# EasyEDA Pro project ProProject_IMUSensorNodes202312.epro, board 1_4_拼板20240123（带编号）
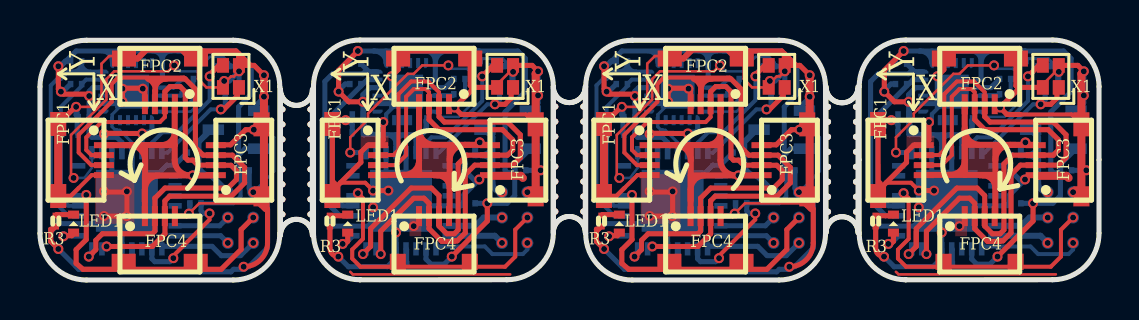
[diagram p4: board, top side]
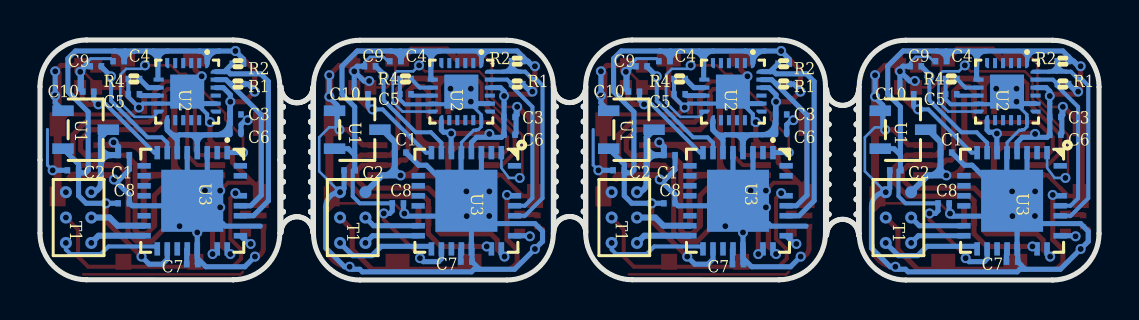
[diagram p5: board, bottom side, seen from below]

Outline 52.99 x 12.01 mm; copper layers: Top Layer, Bottom Layer. Coordinates in mm from the lower left corner of the outline.
Outline path: 0,9.67 0,2.33 arc(0.68,0.68) 2.33,0 9.67,0 arc(11.32,0.68) 12,2.33 12,9.67 arc(11.32,11.32) 9.67,12 2.33,12 arc(0.68,11.32) 0,9.67 ; 13.69,9.68 arc(14.37,11.33) 16.02,12.01 23.35,12.01 arc(25,11.33) 25.69,9.68 25.69,2.34 arc(25,0.7) 23.35,0.01 16.01,0.01 16.02,0.01 arc(14.37,0.7) 13.69,2.35 13.69,9.68 ; 27.31,9.67 27.31,2.33 arc(27.99,0.68) 29.64,0 36.97,0 arc(38.62,0.68) 39.31,2.33 39.31,9.67 arc(38.62,11.32) 36.97,12 29.64,12 arc(27.99,11.32) 27.31,9.67 ; 40.99,9.68 arc(41.67,11.33) 43.32,12.01 50.66,12.01 arc(52.31,11.33) 52.99,9.68 52.99,2.34 arc(52.31,0.7) 50.66,0.01 43.31,0.01 43.32,0.01 arc(41.67,0.7) 40.99,2.35 40.99,9.68
Stack: Top Layer 0.035mm / Dielectric1 1.51mm FR4 er 4.5 / Bottom Layer 0.035mm

## Design rules (mm)
template: 自定义配置
spacing copperThickness1oz (default): track to track 0.102, other pairs 0.152 to 0.3
spacing copperThickness2oz: track to track 0.203, other pairs 0.152 to 0.3
track width copperThickness1oz (default): min 0.127, default 0.254, max 2.54
track width copperThickness2oz: min 0.203, default 0.254, max 2.54
differential pair differentialPair (default): width min 0.127, default 0.254, max 2.54; gap min 0.152, default 0.152
via viaSize (default): diameter min 0.5, default 0.61, max 10; hole min 0.3, default 0.305, max 6.299
net GND uses copperRegion1

## Placement (name value [footprint] x y rotation side)
C1  -  [C0201]  7.65 6.38 180 bottom
C1#2  -  [C0201]  21.49 6.25 180 bottom
C1#3  -  [C0201]  34.96 6.38 180 bottom
C1#4  -  [C0201]  48.8 6.25 180 bottom
C2  -  [C0201]  10.19 5.49 0 bottom
C2#2  -  [C0201]  24.03 5.49 0 bottom
C2#3  -  [C0201]  37.5 5.49 0 bottom
C2#4  -  [C0201]  51.34 5.49 0 bottom
C3  -  [C0201]  15.91 8.28 180 bottom
C3#2  -  [C0201]  2.19 8.16 180 bottom
C3#3  -  [C0201]  29.5 8.16 180 bottom
C3#4  -  [C0201]  43.21 8.28 180 bottom
C4  -  [C0201]  7.91 10.95 0 bottom
C4#2  -  [C0201]  21.75 10.95 0 bottom
C4#3  -  [C0201]  35.21 10.95 0 bottom
C4#4  -  [C0201]  49.05 10.95 0 bottom
C5  -  [C0201]  7.4 9.3 180 bottom
C5#2  -  [C0201]  20.99 9.3 180 bottom
C5#3  -  [C0201]  34.7 9.3 180 bottom
C5#4  -  [C0201]  48.29 9.3 180 bottom
C6  -  [C0201]  2.19 7.27 0 bottom
C6#2  -  [C0201]  15.91 7.39 0 bottom
C6#3  -  [C0201]  29.5 7.27 0 bottom
C6#4  -  [C0201]  43.21 7.39 0 bottom
C7  -  [C0201]  4.35 0.92 0 bottom
C7#2  -  [C0201]  18.06 0.79 0 bottom
C7#3  -  [C0201]  31.65 0.92 0 bottom
C7#4  -  [C0201]  45.37 0.79 0 bottom
C8  -  [C0201]  21.49 3.84 180 bottom
C8#2  -  [C0201]  7.78 3.84 180 bottom
C8#3  -  [C0201]  35.08 3.84 180 bottom
C8#4  -  [C0201]  48.8 3.84 180 bottom
C9  -  [C0201]  9.17 10.7 180 bottom
C9#2  -  [C0201]  22.89 10.7 180 bottom
C9#3  -  [C0201]  36.48 10.7 180 bottom
C9#4  -  [C0201]  50.2 10.7 180 bottom
C10  -  [C0201]  9.56 9.3 0 bottom
C10#2  -  [C0201]  23.27 9.43 0 bottom
C10#3  -  [C0201]  36.86 9.3 0 bottom
C10#4  -  [C0201]  50.58 9.43 0 bottom
FPC1  -  [fpc-0.5mm-4p-h1.0#2]  44.22 6 270 top
FPC1#2  -  [fpc-0.5mm-4p-h1.0#2]  16.92 6 270 top
FPC1#3  -  [fpc-0.5mm-4p-h1.0#2]  3.2 6 270 top
FPC1#4  -  [fpc-0.5mm-4p-h1.0#2]  30.5 6 270 top
FPC2  -  [fpc-0.5mm-4p-h1.0#2]  6 8.8 180 top
FPC2#2  -  [fpc-0.5mm-4p-h1.0#2]  19.72 8.8 180 top
FPC2#3  -  [fpc-0.5mm-4p-h1.0#2]  47.02 8.8 180 top
FPC2#4  -  [fpc-0.5mm-4p-h1.0#2]  33.31 8.8 180 top
FPC3  -  [fpc-0.5mm-4p-h1.0#3]  36.1 6 90 top
FPC3#2  -  [fpc-0.5mm-4p-h1.0#3]  22.52 6 90 top
FPC3#3  -  [fpc-0.5mm-4p-h1.0#3]  49.82 6 90 top
FPC3#4  -  [fpc-0.5mm-4p-h1.0#3]  8.8 6 90 top
FPC4  -  [fpc-0.5mm-4p-h1.0]  47.02 3.2 0 top
FPC4#2  -  [fpc-0.5mm-4p-h1.0]  19.72 3.2 0 top
FPC4#3  -  [fpc-0.5mm-4p-h1.0#2]  33.31 3.2 0 top
FPC4#4  -  [fpc-0.5mm-4p-h1.0#2]  6 3.2 0 top
LED1  -  [LED0402]  1.68 2.82 90 top
LED1#2  -  [LED0402]  15.4 2.82 90 top
LED1#3  -  [LED0402]  28.99 2.82 90 top
LED1#4  -  [LED0402]  42.7 2.82 90 top
R1  -  [R0201]  1.81 9.81 0 bottom
R1#2  -  [R0201]  15.78 9.81 0 bottom
R1#3  -  [R0201]  29.11 9.81 0 bottom
R1#4  -  [R0201]  43.08 9.81 0 bottom
R2  -  [R0201]  1.81 10.95 0 bottom
R2#2  -  [R0201]  15.78 10.82 0 bottom
R2#3  -  [R0201]  29.11 10.95 0 bottom
R2#4  -  [R0201]  43.08 10.82 0 bottom
R3  -  [R0201]  41.81 2.95 270 top
R3#2  -  [R0201]  0.79 2.95 270 top
R3#3  -  [R0201]  14.51 2.95 270 top
R3#4  -  [R0201]  28.1 2.95 270 top
R4  -  [R0201]  7.4 10.06 180 bottom
R4#2  -  [R0201]  20.99 10.06 180 bottom
R4#3  -  [R0201]  34.7 10.06 180 bottom
R4#4  -  [R0201]  48.29 10.06 180 bottom
T1  -  [test]  50.42 4.4 270 bottom
T1#2  -  [test]  23.12 4.4 270 bottom
T1#3  -  [test]  9.4 4.4 270 bottom
T1#4  -  [test]  36.71 4.4 270 bottom
U1  -  [SOT-23-3_L2.9-W1.6-P1.90-LS2.8-BR]  9.81 7.52 0 bottom
U1#2  -  [SOT-23-3_L2.9-W1.6-P1.90-LS2.8-BR]  23.4 7.52 0 bottom
U1#3  -  [SOT-23-3_L2.9-W1.6-P1.90-LS2.8-BR]  37.12 7.52 0 bottom
U1#4  -  [SOT-23-3_L2.9-W1.6-P1.90-LS2.8-BR]  50.7 7.52 0 bottom
U2  -  [qfn-24_l3.0-w3.0-p0.40-bl-ep]  31.91 9.43 0 bottom
U2#2  -  [qfn-24_l3.0-w3.0-p0.40-bl-ep]  4.6 9.43 0 bottom
U2#3  -  [qfn-24_l3.0-w3.0-p0.40-bl-ep#2]  45.62 9.43 0 bottom
U2#4  -  [qfn-24_l3.0-w3.0-p0.40-bl-ep#2]  18.32 9.43 0 bottom
U3  -  [邮票孔]  13.02 6 0 top
U3#2  -  [邮票孔]  26.68 6.14 0 top
U3#3  -  [邮票孔]  40.32 6.13 0 top
U3#4  -  [vqfn-32_l5.0-w5.0-p0.50-tl-ep3.1]  18.06 3.97 270 bottom
U3#5  -  [vqfn-32_l5.0-w5.0-p0.50-tl-ep3.1#2]  4.35 3.97 270 bottom
U3#6  -  [vqfn-32_l5.0-w5.0-p0.50-tl-ep3.1]  45.37 3.97 270 bottom
U3#7  -  [vqfn-32_l5.0-w5.0-p0.50-tl-ep3.1#2]  31.65 3.97 270 bottom
X1  -  [CRYSTAL-SMD_4P-L1.6-W1.2-BL]  9.56 10.19 90 top
X1#2  -  [CRYSTAL-SMD_4P-L1.6-W1.2-BL]  23.27 10.19 90 top
X1#3  -  [CRYSTAL-SMD_4P-L1.6-W1.2-BL]  36.86 10.19 90 top
X1#4  -  [CRYSTAL-SMD_4P-L1.6-W1.2-BL]  50.58 10.19 90 top

## Footprints (pads in the part's own frame, mm; a bottom-side part is the same pattern mirrored in y, then rotated)
C0201
  rect 0.28x0.318 smd: 1(-0.28,0) 2(0.28,0)
CRYSTAL-SMD_4P-L1.6-W1.2-BL
  rect 0.73x0.6 smd: 1(-0.55,-0.4) 2(0.55,-0.4) 3(0.55,0.4) 4(-0.55,0.4)
fpc-0.5mm-4p-h1.0
  rect 0.3x1 smd: 1(-0.75,0) 2(-0.251,0) 3(0.249,0) 4(0.75,0)
  rect 0.8x0.8 smd: 5(-1.81,-2.286) 6(1.794,-2.286)
fpc-0.5mm-4p-h1.0#2
  rect 0.3x1 smd: 1(-0.75,0) 2(-0.251,0) 3(0.249,0) 4(0.75,0)
  rect 1.2x0.8 smd: 5(-1.81,-2.286) 6(1.794,-2.286)
fpc-0.5mm-4p-h1.0#3
  rect 0.3x1 smd: 1(-0.75,0) 2(-0.251,0) 3(0.249,0) 4(0.75,0)
  rect 1x0.8 smd: 5(-1.81,-2.286)
  rect 1.2x0.8 smd: 6(1.794,-2.286)
LED0402
  rect 0.4x0.55 smd: 1(-0.45,0) 2(0.45,0)
qfn-24_l3.0-w3.0-p0.40-bl-ep
  custom 0.2x0.506 smd: 1(-1,-1.427) 6(1,-1.427) 13(1,1.427) 18(-1,1.427)
  rect 0.2x0.505 smd: 2(-0.6,-1.427) 3(-0.2,-1.427) 4(0.2,-1.427) 5(0.6,-1.427) 14(0.6,1.427) 15(0.2,1.427) 16(-0.2,1.427) 17(-0.6,1.427)
  rect 0.505x0.2 smd: 8(1.427,-0.6) 9(1.427,-0.2) 10(1.427,0.2) 11(1.427,0.6) 20(-1.427,0.6) 21(-1.427,0.2) 22(-1.427,-0.2) 23(-1.427,-0.6)
  custom 0.506x0.2 smd: 12(1.427,1) 19(-1.427,1) 24(-1.427,-1)
  rect 1.7x1.7 smd: 25(0,0)
qfn-24_l3.0-w3.0-p0.40-bl-ep#2
  custom 0.2x0.506 smd: 1(-1,-1.427) 6(1,-1.427) 13(1,1.427) 18(-1,1.427)
  rect 0.2x0.505 smd: 2(-0.6,-1.427) 3(-0.2,-1.427) 4(0.2,-1.427) 5(0.6,-1.427) 14(0.6,1.427) 15(0.2,1.427) 16(-0.2,1.427) 17(-0.6,1.427)
  rect 0.003x0.003 smd: 7(1.425,-0.997)
  rect 0.505x0.2 smd: 8(1.427,-0.6) 9(1.427,-0.2) 10(1.427,0.2) 11(1.427,0.6) 20(-1.427,0.6) 21(-1.427,0.2) 22(-1.427,-0.2) 23(-1.427,-0.6)
  custom 0.506x0.2 smd: 12(1.427,1) 19(-1.427,1) 24(-1.427,-1)
  rect 1.7x1.7 smd: 25(0,0)
R0201
  rect 0.28x0.318 smd: 1(-0.28,0) 2(0.28,0)
SOT-23-3_L2.9-W1.6-P1.90-LS2.8-BR
  rect 1.07x0.532 smd: 1(1.135,-0.95) 2(1.135,0.95) 3(-1.135,0)
test
  round 0.6 smd: 1(0,0) 2(1.27,0) 3(2.54,0) 4(0,-1.27) 5(1.27,-1.27) 6(2.54,-1.27)
vqfn-32_l5.0-w5.0-p0.50-tl-ep3.1
  rect 0.665x0.28 smd: 1(-2.408,1.75) 2(-2.408,1.25) 3(-2.408,0.75) 4(-2.408,0.25) 5(-2.408,-0.25) 6(-2.408,-0.75) 7(-2.408,-1.25) 8(-2.408,-1.75) 17(2.408,-1.75) 18(2.408,-1.25) 19(2.408,-0.75) 20(2.408,-0.25) 21(2.408,0.25) 23(2.408,1.25) 24(2.408,1.75)
  rect 0.28x0.665 smd: 9(-1.75,-2.408) 10(-1.25,-2.408) 11(-0.75,-2.408) 12(-0.25,-2.408) 14(0.75,-2.408) 15(1.25,-2.408) 16(1.75,-2.408) 25(1.75,2.408) 27(0.75,2.408) 28(0.25,2.408) 29(-0.25,2.408) 31(-1.25,2.408) 32(-1.75,2.408)
  rect 3.1x3.1 smd: 33(0,0)
vqfn-32_l5.0-w5.0-p0.50-tl-ep3.1#2
  rect 0.665x0.28 smd: 1(-2.408,1.75) 2(-2.408,1.25) 3(-2.408,0.75) 4(-2.408,0.25) 5(-2.408,-0.25) 6(-2.408,-0.75) 7(-2.408,-1.25) 8(-2.408,-1.75) 17(2.408,-1.75) 18(2.408,-1.25) 19(2.408,-0.75) 20(2.408,-0.25) 21(2.408,0.25) 23(2.408,1.25) 24(2.408,1.75)
  rect 0.28x0.665 smd: 10(-1.25,-2.408) 11(-0.75,-2.408) 12(-0.25,-2.408) 13(0.254,-2.413) 15(1.25,-2.408) 16(1.75,-2.408) 25(1.75,2.408) 27(0.75,2.408) 28(0.25,2.408) 29(-0.25,2.408) 32(-1.75,2.408)
  rect 0.003x0.003 smd: 13(0.25,-2.408)
  rect 3.1x3.1 smd: 33(0,0)
邮票孔
  round 0.3 hole 0.315x0.3: 1(0.508,2.54) 2(0.508,1.79) 3(0.508,1.04) 4(0.508,0.29) 5(0.508,-0.46) 6(0.508,-1.21) 7(0.508,-1.96) 8(0.508,-2.71) 9(-0.892,2.54) 10(-0.892,1.79) 11(-0.892,1.04) 12(-0.892,0.29) 13(-0.892,-0.46) 14(-0.892,-1.21) 15(-0.892,-1.96) 16(-0.892,-2.71)

## Nets
3V3: C2.1 C2#2.1 C2#3.1 C2#4.1 C3.1 C3#2.1 C3#3.1 C3#4.1 C4.1 C4#2.1 C4#3.1 C4#4.1 C6.2 C6#2.2 C6#3.2 C6#4.2 C8.1 C8#2.1 C8#3.1 C8#4.1 R1.1 R1#2.1 R1#3.1 R1#4.1 R2.1 R2#2.1 R2#3.1 R2#4.1 U1.2 U1#2.2 U1#3.2 U1#4.2 U2.1 U2.8 U2.13 U2.22 U2#2.1 U2#2.8 U2#2.13 U2#2.22 U2#3.1 U2#3.8 U2#3.13 U2#3.22 U2#4.1 U2#4.8 U2#4.13 U2#4.22 U3#4.4 U3#4.6 U3#4.18 U3#5.4 U3#5.6 U3#5.18 U3#6.4 U3#6.6 U3#6.18 U3#7.4 U3#7.6 U3#7.18
5V: C1.1 C1#2.1 C1#3.1 C1#4.1 FPC1.4 FPC1#2.4 FPC1#3.1 FPC1#4.1 FPC2.1 FPC2#2.4 FPC2#3.4 FPC2#4.1 FPC3.1 FPC3#2.4 FPC3#3.4 FPC3#4.1 FPC4.4 FPC4#2.4 FPC4#3.1 FPC4#4.1 T1.1 T1#2.1 T1#3.1 T1#4.1 U1.3 U1#2.3 U1#3.3 U1#4.3
GND: C1.2 C1#2.2 C1#3.2 C1#4.2 C2.2 C2#2.2 C2#3.2 C2#4.2 C3.2 C3#2.2 C3#3.2 C3#4.2 C4.2 C4#2.2 C4#3.2 C4#4.2 C5.1 C5#2.1 C5#3.1 C5#4.1 C6.1 C6#2.1 C6#3.1 C6#4.1 C7.1 C7#2.1 C7#3.1 C7#4.1 C8.2 C8#2.2 C8#3.2 C8#4.2 C9.1 C9#2.1 C9#3.1 C9#4.1 C10.2 C10#2.2 C10#3.2 C10#4.2 FPC1.1 FPC1.5 FPC1.6 FPC1#2.1 FPC1#2.5 FPC1#2.6 FPC1#3.4 FPC1#3.5 FPC1#3.6 FPC1#4.4 FPC1#4.5 FPC1#4.6 FPC2.4 FPC2.5 FPC2.6 FPC2#2.1 FPC2#2.5 FPC2#2.6 FPC2#3.1 FPC2#3.5 FPC2#3.6 FPC2#4.4 FPC2#4.5 FPC2#4.6 FPC3.4 FPC3.5 FPC3.6 FPC3#2.1 FPC3#2.5 FPC3#2.6 FPC3#3.1 FPC3#3.5 FPC3#3.6 FPC3#4.4 FPC3#4.5 FPC3#4.6 FPC4.1 FPC4#2.1 FPC4#3.4 FPC4#4.4 R3.2 R3#2.2 R3#3.2 R3#4.2 R4.1 R4#2.1 R4#3.1 R4#4.1 T1.4 T1#2.4 T1#3.4 T1#4.4 U1.1 U1#2.1 U1#3.1 U1#4.1 U2.11 U2.18 U2.20 U2.25 U2#2.11 U2#2.18 U2#2.20 U2#2.25 U2#3.11 U2#3.18 U2#3.20 U2#3.25 U2#4.11 U2#4.18 U2#4.20 U2#4.25 U3#4.3 U3#4.5 U3#4.21 U3#4.33 U3#5.3 U3#5.5 U3#5.21 U3#5.33 U3#6.3 U3#6.5 U3#6.21 U3#6.33 U3#7.3 U3#7.5 U3#7.21 U3#7.33 X1.2 X1.4 X1#2.2 X1#2.4 X1#3.2 X1#3.4 X1#4.2 X1#4.4
IMU_INT: U2.12 U2#2.12 U2#3.12 U2#4.12 U3#4.1 U3#5.1 U3#6.1 U3#7.1
LED1: LED1.1 LED1#2.1 LED1#3.1 LED1#4.1 U3#4.25 U3#5.25 U3#6.25 U3#7.25
MISO: T1.3 T1#2.3 T1#3.3 T1#4.3 U3#4.16 U3#5.16 U3#6.16 U3#7.16
MOSI: T1.2 T1#2.2 T1#3.2 T1#4.2 U3#4.15 U3#5.15 U3#6.15 U3#7.15
RESET: FPC4.5 FPC4.6 FPC4#2.5 FPC4#2.6 FPC4#3.5 FPC4#3.6 FPC4#4.5 FPC4#4.6 T1.5 T1#2.5 T1#3.5 T1#4.5 U3#4.29 U3#5.29 U3#6.29 U3#7.29
SCK: T1.6 T1#2.6 T1#3.6 T1#4.6 U3#4.17 U3#5.17 U3#6.17 U3#7.17
SCL: R1.2 R1#2.2 R1#3.2 R1#4.2 U2.23 U2#2.23 U2#3.23 U2#4.23 U3#4.28 U3#5.28 U3#6.28 U3#7.28
SDA: R2.2 R2#2.2 R2#3.2 R2#4.2 U2.24 U2#2.24 U2#3.24 U2#4.24 U3#4.27 U3#5.27 U3#6.27 U3#7.27
SOFTSCL: FPC1.2 FPC1#2.2 FPC1#3.3 FPC1#4.3 FPC2.3 FPC2#2.2 FPC2#3.2 FPC2#4.3 FPC3.3 FPC3#2.2 FPC3#3.2 FPC3#4.3 FPC4.2 FPC4#2.2 FPC4#3.3 FPC4#4.3 U3#4.23 U3#5.23 U3#6.23 U3#7.23
SOFTSDA: FPC1.3 FPC1#2.3 FPC1#3.2 FPC1#4.2 FPC2.2 FPC2#2.3 FPC2#3.3 FPC2#4.2 FPC3.2 FPC3#2.3 FPC3#3.3 FPC3#4.2 FPC4.3 FPC4#2.3 FPC4#3.2 FPC4#4.2 U3#4.24 U3#5.24 U3#6.24 U3#7.24
XTAL1: C9.2 C9#2.2 C9#3.2 C9#4.2 U3#4.7 U3#5.7 U3#6.7 U3#7.7 X1.3 X1#2.3 X1#3.3 X1#4.3
XTAL2: C10.1 C10#2.1 C10#3.1 C10#4.1 U3#4.8 U3#5.8 U3#6.8 U3#7.8 X1.1 X1#2.1 X1#3.1 X1#4.1
$1N1083: LED1.2 LED1#3.2 R3#2.1 R3#4.1
$1N1108: C7.2 C7#3.2 U3#5.20 U3#7.20
$1N1134: LED1#2.2 LED1#4.2 R3.1 R3#3.1
$1N1156: C7#2.2 C7#4.2 U3#4.20 U3#6.20
$1N1216: R4#2.2 R4#4.2 U2#3.9 U2#4.9
$1N1217: C5#2.2 C5#4.2 U2#3.10 U2#4.10
$1N1698: R4.2 R4#3.2 U2.9 U2#2.9
$1N1725: C5.2 C5#3.2 U2.10 U2#2.10

Pads without a net: U2 2 3 4 5 6 14 15 16 17 19 21; U2#2 2 3 4 5 6 14 15 16 17 19 21; U2#3 2 3 4 5 6 7 14 15 16 17 19 21; U2#4 2 3 4 5 6 7 14 15 16 17 19 21; U3 1 2 3 4 5 6 7 8 9 10 11 12 13 14 15 16; U3#2 1 2 3 4 5 6 7 8 9 10 11 12 13 14 15 16; U3#3 1 2 3 4 5 6 7 8 9 10 11 12 13 14 15 16; U3#4 2 9 10 11 12 14 19 31 32; U3#5 2 10 11 12 13 19 32; U3#6 2 9 10 11 12 14 19 31 32; U3#7 2 10 11 12 13 19 32

## Via types
v1: diameter 0.5, hole 0.3, Top Layer to Bottom Layer, 132 vias
v2: diameter 0.5, hole 0.299, Top Layer to Bottom Layer, 12 vias

## Routing (per net, layer and track width the routed paths; a pad name or vN(x,y) marks a point on that pad's centre or on a via; arc(x,y) is an arc through that point)
3V3: length 127.2
  Top Layer w0.254: v1(16.16,8.92) 15.45,8.92 v1(14.94,9.43) ; v1(43.47,8.92) 42.75,8.92 v1(42.25,9.43) ; v1(2.46,9.21) 2.37,9.3 1.17,9.3 v1(1.05,9.43) 0.92,9.55 v1(0.92,10.7) ; v1(28.22,10.7) 28.22,9.55 v1(28.35,9.43) 28.48,9.3 29.68,9.3 v1(29.77,9.21) ; v1(22.38,3.84) 22.38,2.95 v1(20.6,1.17) ; v1(49.69,3.84) 49.69,2.95 v1(47.91,1.17)
  Bottom Layer w0.2: U2.1 30.91,11.44 30.89,11.46 29.11,11.46 ; U2#2.1 3.6,11.44 3.59,11.46 1.81,11.46
  Bottom Layer w0.254: C2#2.1 23.75,5.79 U1#2.2 ; C2#2.1 23.63,5.36 23.4,5.36 23.27,5.49 23.27,8.41 24.29,9.43 24.29,11.08 23.91,11.46 21.98,11.46 ; C2#2.1 23.75,4.22 23.37,3.84 v1(22.38,3.84) C8.1 ; 8.13,11.46 7.65,11.46 7.63,11.43 C4.1 ; 8.13,11.46 9.81,11.46 10.57,10.7 10.57,9.3 9.94,8.67 9.94,6.25 ; 8.13,11.46 arc(7.77,11.31) C4.1 ; U2.8 33.43,10.12 33.43,11.08 ; v1(20.6,1.17) 20.22,0.79 19.57,0.79 19.31,1.05 U3#4.18 ; 20.04,11.44 20.01,11.46 ; 20.01,11.46 20.38,11.46 ; 20.01,11.46 19.29,11.46 ; 48.27,11.46 48.73,11.46 ; 48.27,11.46 47.69,11.46 ; 48.27,11.46 arc(48.62,11.31) C4#4.1 ; 48.73,11.46 48.77,11.42 C4#4.1 ; 48.73,11.46 49.28,11.46 ; 37.24,6.25 37.56,6.57 38.12,6.57 ; 37.24,6.25 37.24,8.67 37.88,9.3 37.88,10.7 37.12,11.46 35.44,11.46 ; 37.24,6.25 37.24,5.52 C2#3.1 ; 10.82,6.57 10.26,6.57 9.94,6.25 ; 46.59,11.46 47.32,11.46 ; 46.59,11.46 45.02,11.46 ; 46.59,11.46 arc(46.94,11.31) 47.09,10.97 47.09,11.44 ; 47.32,11.46 47.69,11.46 ; 47.32,11.46 47.34,11.44 ; 1.01,10.7 1.05,10.7 1.3,10.95 ; 1.01,10.7 v1(0.92,10.7) ; 1.01,10.7 1.26,10.95 1.3,10.95 ; v1(14.94,9.43) 14.94,9.48 15.27,9.81 R1#2.1 ; 1.3,10.95 1.53,11.18 ; 1.3,10.95 R2.1 1.53,11.18 ; 28.61,10.95 28.57,10.95 28.31,10.7 ; 28.61,10.95 28.35,10.7 28.31,10.7 ; 28.61,10.95 28.83,11.18 ; 28.61,10.95 R2#3.1 28.83,11.18 ; R1#3.1 28.45,9.43 v1(28.35,9.43) ; 17.32,11.06 17.32,11.46 ; 17.32,11.06 U2#4.1 arc(17.14,11.28) 16.71,11.46 ; 17.32,11.06 arc(17.44,11.34) 17.72,11.46 ; 9.94,6.25 9.94,5.52 C2.1 ; v1(47.91,1.17) 47.53,0.79 46.87,0.79 46.62,1.05 U3#6.18 ; 16.71,11.46 v1(15.91,11.46) 15.5,11.05 R2#2.1 ; 16.71,11.46 17.72,11.46 ; 44.02,11.46 v1(43.21,11.46) 42.8,11.05 R2#4.1 ; 44.02,11.46 45.02,11.46 ; 44.02,11.46 arc(44.45,11.28) U2#3.1 44.62,11.06 ; 20.96,11.46 20.38,11.46 ; 20.96,11.46 21.43,11.46 ; 20.96,11.46 arc(21.32,11.31) C4#2.1 ; 20.38,11.46 arc(19.96,11.28) 19.78,10.86 ; 35.44,11.46 34.96,11.46 34.93,11.43 C4#3.1 ; 35.44,11.46 arc(35.08,11.31) C4#3.1 ; C2#4.1 51.06,4.22 50.68,3.84 v1(49.69,3.84) C8#4.1 ; C2#4.1 50.93,5.36 50.7,5.36 50.58,5.49 50.58,8.41 51.59,9.43 51.59,11.08 51.21,11.46 49.28,11.46 ; C2#4.1 51.06,5.79 U1#4.2 ; 28.83,11.18 29.11,11.46 ; 21.43,11.46 21.47,11.42 C4#2.1 ; 21.43,11.46 21.98,11.46 ; 44.62,11.06 44.62,11.46 ; 44.62,11.06 arc(44.74,11.34) 45.02,11.46 ; 49.28,11.46 arc(48.92,11.31) C4#4.1 ; 18.83,7.14 18.7,7.27 16.19,7.27 C3.1 16.19,8.89 v1(16.16,8.92) 16.16,9.28 16.51,9.63 16.89,9.63 ; R1.1 1.15,9.43 v1(1.05,9.43) ; 28.31,10.7 v1(28.22,10.7) ; 46.13,7.14 46,7.27 43.49,7.27 C3#4.1 43.49,8.89 v1(43.47,8.92) 43.47,9.28 43.82,9.63 44.2,9.63 ; R1#4.1 42.58,9.81 42.25,9.48 v1(42.25,9.43) ; 21.98,11.46 arc(21.62,11.31) C4#2.1 ; 47.69,11.46 arc(47.26,11.28) 47.09,10.86 ; 34.19,11.46 34.42,11.46 arc(34.78,11.31) C4#3.1 ; 19.29,11.46 17.72,11.46 ; 19.29,11.46 arc(19.64,11.31) 19.78,10.97 19.78,11.44 ; 6.89,11.46 7.12,11.46 arc(7.48,11.31) C4.1 ; 1.53,11.18 1.81,11.46 ; U2#2.13 5.6,7.51 5.49,7.39 5.17,7.39 v2(5.11,7.33) 5.11,6.39 U3#5.6 ; 6.13,11.08 6.13,10.12 U2#2.8 ; U3#7.6 32.42,6.39 v2(32.42,7.33) 32.48,7.39 32.8,7.39 32.91,7.51 U2.13
  vias: v1(6.67,1.09) v1(8.48,3.33) v1(33.98,1.09) v1(35.79,3.33) v2(3.2,7.31) v2(30.5,7.31)
5V: length 9.2
  Bottom Layer w0.3: 49.57,7.52 49.94,7.15 49.94,6.84 ; v1(22,6.89) 21.77,6.66 C1#2.1 22.13,6.25 ; 49.43,6.25 49.69,6.25 ; 49.43,6.25 C1#4.1 49.08,6.66 v1(49.31,6.89) ; 49.43,6.25 arc(49.79,6.1) 49.94,5.74 49.94,4.88 arc(50.08,4.54) v1(50.42,4.4) ; 22.64,6.84 22.64,7.15 U1#2.3 ; 22.13,6.25 22.38,6.25 ; 22.13,6.25 arc(22.49,6.1) 22.64,5.74 22.64,4.88 arc(22.78,4.54) v1(23.12,4.4)
  vias: v1(7.64,5.23) v1(34.95,5.23)
GND: length 192.3
  Top Layer w0.127: X1#2.2 23.67,10.59 22.87,9.79 22.87,9.64 ; FPC3.5 38.04,3.84 35.27,3.84 v1(34.76,3.33) ; 9.16,9.64 9.16,9.79 9.56,10.19 9.71,10.19 v2(9.96,10.44) ; 50.18,9.64 50.18,9.79 50.98,10.59 X1#4.2 ; v2(37.27,10.44) 37.01,10.19 36.86,10.19 36.46,9.79 36.46,9.64 ; FPC3#4.5 10.74,3.84 7.97,3.84 v1(7.45,3.33) ; v1(1.81,8.67) 2.64,8.67 3.08,9.11 3.08,10.82 3.46,11.2 4.08,11.2 FPC2.6 ; FPC2#4.6 31.39,11.2 30.76,11.2 30.38,10.82 30.38,9.11 29.94,8.67 v1(29.11,8.67)
  Top Layer w0.2: 49.05,8.28 51.62,8.28 FPC3#3.6 ; FPC1#3.4 2.58,5.25 1.94,4.6 ; 29.24,4.6 29.89,5.25 FPC1#4.4 ; 15.03,4.87 16.27,4.87 v1(16.67,4.47) ; FPC3#2.6 24.31,8.28 21.75,8.28 ; v1(43.97,4.47) 43.58,4.87 42.34,4.87
  Top Layer w0.22: 29.24,4.6 28.84,4.2 FPC1#4.6 ; FPC1#3.6 1.54,4.2 1.94,4.6
  Top Layer w0.254: 21.61,9.64 21.53,9.73 FPC2#2.5 21.15,11.46 18.3,11.46 FPC2#2.6 17.92,10.52 v1(17.59,10.2) ; 21.61,9.64 22.87,9.64 ; 21.61,9.64 21.61,9.51 v1(20.73,8.63) 21.08,8.28 21.75,8.28 ; v1(15.29,8) 14.82,8 FPC1#2.5 14.63,4.46 ; v1(38.51,10.25) 38.02,10.74 37.84,10.74 ; 41.94,4.46 43.36,5.89 43.36,6.4 43.71,6.75 FPC1.1 ; 41.94,4.46 FPC1.5 42.12,8 v1(42.6,8) ; 41.94,4.46 FPC1.6 ; FPC2#4.5 35.49,11.46 37.12,11.46 37.24,11.33 ; 37.24,11.33 37.84,10.74 ; 37.24,11.33 37.24,10.76 X1#3.2 37.84,10.74 ; 50.18,9.64 48.92,9.64 ; 48.92,9.64 48.83,9.73 FPC2#3.5 48.46,11.46 45.6,11.46 FPC2#3.6 45.23,10.52 v1(44.9,10.2) ; 48.92,9.64 48.92,9.51 v1(48.04,8.63) 48.38,8.28 49.05,8.28 ; FPC1#2.6 14.63,4.46 ; 14.63,4.46 16.05,5.89 16.05,6.4 16.4,6.75 FPC1#2.1 ; 9.94,11.33 9.94,10.76 X1.2 10.53,10.74 ; 9.94,11.33 10.53,10.74 ; 9.94,11.33 9.81,11.46 8.19,11.46 FPC2.5 ; FPC1#4.5 29.08,8.67 v1(29.11,8.67) ; R3.2 41.81,1.59 arc(41.94,1.29) v1(42.23,1.17) ; 10.53,10.74 10.72,10.74 v1(11.21,10.25) ; FPC1#3.5 1.77,8.67 v1(1.81,8.67) ; R3#3.2 14.51,1.59 arc(14.63,1.29) v1(14.93,1.17)
  Top Layer w0.4: FPC3#3.5 FPC3#3.6 52.11,10.32 v1(52.23,10.44) ; FPC1#4.5 FPC1#4.6 ; v1(24.92,10.44) 24.8,10.32 FPC3#2.6 FPC3#2.5 ; FPC1#3.5 FPC1#3.6
  Bottom Layer w0.127: 50.85,10.7 50.85,9.43 C10#4.2 ; 50.7,10.7 50.58,10.82 50.58,10.95 ; C4#3.2 35.59,10.95 35.81,11.17 36.48,11.17 36.76,10.89 C9#3.1 ; 23.39,10.7 23.27,10.82 23.27,10.95 ; C10#2.2 23.55,9.43 23.55,10.7 ; C4.2 8.29,10.95 8.5,11.17 9.17,11.17 9.45,10.89 C9.1
  Bottom Layer w0.15: C4#2.2 22.15,11.08 23.15,11.08 23.67,10.55 v1(23.67,10.42) ; C4#4.2 49.46,11.08 50.45,11.08 50.98,10.55 v1(50.98,10.42)
  Bottom Layer w0.152: U3#7.5 31.9,6.89 31.29,7.5 31.17,7.5 31.15,7.52 31.06,7.52 30.91,7.67 U2.18 ; U3#5.5 4.6,6.89 3.99,7.5 3.87,7.5 3.84,7.52 3.75,7.52 3.6,7.67 U2#2.18
  Bottom Layer w0.2: U2#3.18 44.62,8.3 45.62,9.3 U2#3.25 46.22,8.83 47.84,8.83 v1(48.04,8.63) 48.57,9.16 C5#4.1 R4#4.1 ; U3#6.21 v1(45.12,2.38) 45.12,3.72 U3#6.33 ; U3#4.21 v1(17.81,2.38) 17.81,3.72 U3#4.33 ; R4#2.1 C5#2.1 21.27,9.16 v1(20.73,8.63) 20.54,8.83 18.92,8.83 U2#4.25 18.32,9.3 17.32,8.3 U2#4.18 ; 33.34,8.83 33.37,8.79 34.73,8.79 34.98,9.04 C5#3.1 R4#3.1 ; R4.1 C5.1 7.68,9.04 7.43,8.79 6.07,8.79 6.03,8.83
  Bottom Layer w0.254: C1#4.2 48.52,5.52 49,5.03 v1(49.28,5.03) 48.52,4.27 C8#4.2 ; 9.84,9.43 9.96,9.55 v2(9.96,10.44) 9.96,10.55 9.81,10.7 9.58,10.7 ; C3#2.2 1.81,8.26 v1(1.81,8.67) ; C1#2.2 21.21,5.52 21.7,5.03 v1(21.98,5.03) 21.21,4.27 C8.2 ; C9#2.1 23.39,10.7 v1(23.67,10.42) 23.67,9.55 C10#2.2 ; 42.93,7.27 42.93,7.78 42.71,8 v1(42.6,8) ; v1(25.05,5.49) C2#2.2 ; v1(15.29,8) 15.4,8 15.63,7.78 15.63,7.27 ; U3#7.33 30.51,2.82 28.22,2.82 27.84,2.44 27.84,1.93 v1(28.22,1.55) ; C7#2.1 17.81,0.82 U3#4.21 ; v1(0.92,1.55) 0.54,1.93 0.54,2.44 0.92,2.82 3.21,2.82 U3#5.33 ; 16.89,8.83 17.72,8.83 arc(17.79,8.83) 17.86,8.84 arc(18.14,9) 18.3,9.28 arc(18.31,9.35) U2#4.25 ; C10#4.2 50.98,9.55 v1(50.98,10.42) 50.7,10.7 C9#4.1 ; v1(52.35,5.49) C2#4.2 ; U3#6.3 44.62,4.59 v1(44.73,4.47) 45.24,3.97 U3#6.33 45.62,4.22 U3#6.5 ; C7#4.1 45.12,0.82 U3#6.21 ; 36.88,10.7 37.12,10.7 37.27,10.55 v2(37.27,10.44) 37.27,9.55 37.14,9.43 ; v1(29.11,8.67) 29.11,8.26 C3#3.2 ; 44.2,8.83 45.02,8.83 arc(45.1,8.83) 45.17,8.84 arc(45.45,9) 45.61,9.28 arc(45.62,9.35) U2#3.25 ; U3#4.5 18.31,4.22 U3#4.33 17.94,3.97 v1(17.43,4.47) 17.31,4.59 U3#4.3
  vias: v1(3.2,4.43) v1(3.21,3.2) v1(4.13,9.57) v1(4.13,8.92) v1(4.35,4.43) v1(4.33,3.2) v1(5.14,9.57) v1(10.19,0.66) v1(10.7,7.52) v1(11.21,9.17) v1(16.67,3.64) v1(17.18,7.9) v1(18.7,2.7) v1(24.39,4.4) v1(24.92,9.24) v1(30.5,4.43) v1(30.51,3.2) v1(31.43,9.57) v1(31.43,8.92) v1(31.64,3.2) v1(31.65,4.43) v1(32.45,9.57) v1(37.5,0.66) v1(38,7.52) v1(38.51,9.17) v1(43.97,3.64) v1(44.48,7.9) v1(46,2.7) v1(51.69,4.4) v1(52.23,9.24) v2(9.22,9.96) v2(10.67,4.4) v2(36.52,9.96) v2(37.98,4.4)
IMU_INT: length 53.9
  Top Layer w0.127: v1(15.53,6.38) 15.53,7.14 16.41,8.03 16.41,8.33 18.4,10.32 18.7,10.32 19.12,10.74 v1(20.43,10.74) ; v1(34.02,10.74) 33.72,10.44 31.02,10.44 30.63,10.05 30.63,9.03 28.86,7.26 28.86,5.24 v2(28.99,5.11) ; v1(6.72,10.74) 6.42,10.44 3.71,10.44 3.32,10.05 3.32,9.03 1.55,7.26 1.55,5.24 v2(1.68,5.11) ; v1(47.74,10.74) 46.43,10.74 46,10.32 45.7,10.32 43.72,8.33 43.72,8.03 42.83,7.14 v1(42.83,6.38)
  Bottom Layer w0.127: U2#3.12 47.31,8.17 48.26,8.17 48.97,8.87 48.97,10.27 48.67,10.57 47.91,10.57 v1(47.74,10.74) ; v1(6.72,10.74) 7.01,10.44 7.83,10.44 7.98,10.29 7.98,10.11 8.03,10.06 8.03,8.92 7.54,8.43 U2#2.12 ; v1(20.43,10.74) 20.6,10.57 21.37,10.57 21.66,10.27 21.66,8.87 20.95,8.17 20.01,8.17 U2#4.12 ; U2.12 34.84,8.43 35.34,8.92 35.34,10.06 35.29,10.11 35.29,10.29 35.14,10.44 34.32,10.44 v1(34.02,10.74)
LED1:
  vias: v1(1.17,2.19) v1(15.14,1.81) v1(28.48,2.19) v1(42.45,1.81)
MISO:
  vias: v1(9.4,1.86) v1(23.12,1.86) v1(36.71,1.86) v1(50.42,1.86)
MOSI:
  vias: v1(9.4,3.13) v1(23.12,3.13) v1(36.71,3.13) v1(50.42,3.13)
RESET: length 18.2
  Top Layer w0.2: 23.27,0.66 23.78,1.17 23.78,2.52 v1(24.39,3.13) ; v1(43.21,4.35) 43.47,4.09 43.47,2.06 42.93,1.53 42.93,1.07 43.34,0.66 44.96,0.66 FPC4.5 ; v1(51.69,3.13) 51.09,2.52 51.09,1.17 50.58,0.66 ; FPC4#2.5 17.66,0.66 16.03,0.66 15.62,1.07 15.62,1.53 16.16,2.06 16.16,4.09 v1(15.91,4.35)
  vias: v1(2.32,4.26) v1(10.67,3.13) v1(29.62,4.26) v1(37.98,3.13)
SCK: length 10.4
  Bottom Layer w0.2: U3#4.17 19.94,1.68 22.26,1.68 22.64,1.3 24.16,1.3 24.39,1.53 v1(24.39,1.86) ; U3#6.17 47.24,1.68 49.56,1.68 49.94,1.3 51.47,1.3 51.69,1.53 v1(51.69,1.86)
  vias: v1(10.67,1.86) v1(37.98,1.86)
SCL: length 33.5
  Bottom Layer w0.2: U2#2.23 2.31,10.03 R1.2 2.09,9.71 1.05,8.67 1.05,4.09 1.42,3.72 U3#5.28 ; U3#7.28 28.73,3.72 28.35,4.09 28.35,8.67 29.39,9.71 R1#3.2 29.61,10.03 U2.23
  Bottom Layer w0.254: U3#4.28 15.14,3.72 14.61,4.25 14.61,8.26 16.06,9.71 R1#2.2 16.16,9.81 16.38,10.03 U2#4.23 ; U2#3.23 43.68,10.03 43.47,9.81 R1#4.2 43.36,9.71 41.92,8.26 41.92,4.25 42.44,3.72 U3#6.28
SDA: length 46.7
  Bottom Layer w0.2: 29.41,10.43 29.39,10.45 29.39,10.87 ; 29.41,10.43 28.93,10.43 ; 29.41,10.43 29.84,10.43 ; 28.93,10.43 28.72,10.43 28.35,10.06 28.17,10.06 27.84,9.73 27.84,4.09 28.72,3.22 U3#7.27 ; 28.93,10.43 arc(29.26,10.56) 29.39,10.89 ; 2.11,10.43 1.63,10.43 ; 2.11,10.43 2.09,10.45 2.09,10.87 ; 2.11,10.43 2.53,10.43 ; 1.63,10.43 1.41,10.43 1.05,10.06 0.87,10.06 0.54,9.73 0.54,4.09 1.42,3.22 U3#5.27 ; 1.63,10.43 arc(1.95,10.56) 2.09,10.89 ; 29.39,10.89 29.39,10.87 ; 29.39,10.89 R2#3.2 ; 29.39,10.87 arc(29.52,10.56) 29.84,10.43 ; R2.2 2.09,10.89 ; 2.09,10.89 2.09,10.87 ; 2.09,10.87 arc(2.22,10.56) 2.53,10.43 ; 2.53,10.43 U2#2.24 ; U2.24 29.84,10.43
  Bottom Layer w0.254: 43.76,10.43 R2#4.2 ; 43.76,10.43 43.58,10.43 43.47,10.32 41.94,10.32 41.56,9.94 41.56,3.97 42.31,3.22 U3#6.27 ; 43.76,10.43 U2#3.24 ; U2#4.24 16.46,10.43 ; 16.46,10.43 16.27,10.43 16.16,10.32 14.64,10.32 14.25,9.94 14.25,3.97 15,3.22 U3#4.27 ; 16.46,10.43 R2#2.2
SOFTSCL: length 90.1
  Top Layer w0.2: FPC2#2.2 19.97,9.4 19.43,9.94 18.57,9.94 17.94,9.3 17.94,6.51 17.68,6.25 16.92,6.25 FPC1#2.2 ; FPC1#3.3 2.57,5.75 1.94,6.38 1.94,7.27 3.59,8.92 3.59,9.81 3.91,10.13 7.2,10.13 7.27,10.06 ; 34.57,10.06 34.51,10.13 31.21,10.13 30.89,9.81 30.89,8.92 29.24,7.27 29.24,6.38 29.87,5.75 FPC1#4.3 ; FPC1.2 44.22,6.25 44.99,6.25 45.24,6.51 45.24,9.3 45.88,9.94 46.73,9.94 47.27,9.4 FPC2#3.2
  Top Layer w0.254: FPC2#2.2 19.97,8.17 20.23,7.9 23.4,7.9 24.03,7.27 24.03,6.12 23.66,5.75 FPC3#2.2 21.75,5.75 21.28,5.28 21.28,2.36 20.88,1.96 20.76,1.96 20.73,1.93 20.1,1.93 19.47,2.57 FPC4#2.2 ; FPC4.2 46.77,2.57 47.41,1.93 48.04,1.93 48.06,1.96 48.18,1.96 48.59,2.36 48.59,5.28 49.06,5.75 FPC3#3.2 50.96,5.75 51.34,6.12 51.34,7.27 50.7,7.9 47.54,7.9 47.27,8.17 FPC2#3.2 ; FPC4#4.3 6.25,3.96 6.48,4.19 9.57,4.19 10.24,4.86 10.24,5.64 9.63,6.25 FPC3#4.3 8.16,6.25 7.78,6.63 7.78,9.55 7.27,10.06 6.25,10.06 ; 33.56,10.06 34.57,10.06 35.08,9.55 35.08,6.63 35.47,6.25 FPC3.3 36.93,6.25 37.54,5.64 37.54,4.86 36.88,4.19 33.79,4.19 33.55,3.96 FPC4#3.3
  vias: v1(3.33,1.68) v1(17.05,1.3) v1(30.64,1.68) v1(44.35,1.3)
SOFTSDA: length 70.3
  Top Layer w0.2: FPC2#4.2 33.56,8.15 33.31,7.9 30.38,7.9 29.62,7.14 29.62,6.51 29.88,6.25 FPC1#4.2 ; FPC2.2 6.25,8.15 6,7.9 3.08,7.9 2.32,7.14 2.32,6.51 2.57,6.25 FPC1#3.2 ; FPC2#3.3 46.77,9.4 46.62,9.55 46,9.55 45.62,9.17 45.62,6.25 45.12,5.75 FPC1.3 ; FPC2#2.3 19.47,9.4 19.31,9.55 18.7,9.55 18.32,9.17 18.32,6.25 17.82,5.75 FPC1#2.3
  Top Layer w0.254: 16.54,2.44 16.54,1.68 v1(16.16,1.3) ; FPC2#3.3 46.77,8.03 47.28,7.52 50.45,7.52 50.96,7.01 50.96,6.51 50.7,6.25 FPC3#3.3 48.67,6.25 48.23,5.81 48.23,2.51 48.04,2.31 47.66,2.31 47.27,2.7 FPC4.3 ; FPC4#2.3 19.97,2.7 20.35,2.31 20.73,2.31 20.92,2.51 20.92,5.81 21.36,6.25 FPC3#2.3 23.39,6.25 23.65,6.51 23.65,7.01 23.15,7.52 19.97,7.52 19.47,8.03 FPC2#2.3 ; FPC3.2 35.21,5.75 34.96,6 34.7,6 34.57,6.12 34.57,9.43 34.32,9.68 33.81,9.68 33.56,9.42 FPC2#4.2 ; v1(43.47,1.3) 43.85,1.68 43.85,2.44 ; FPC2.2 6.25,9.42 6.51,9.68 7.02,9.68 7.27,9.43 7.27,6.12 7.4,6 7.65,6 7.9,5.75 FPC3#4.2
  vias: v1(2.44,1.17) v1(29.75,1.17)
XTAL1: length 24.5
  Bottom Layer w0.2: v1(35.79,10.19) 35.79,9 34.19,7.39 33.43,7.39 32.9,6.87 U3#7.7 ; U3#6.7 46.62,6.87 46.89,7.14 47.61,7.14 49.43,8.97 v1(49.43,10.19) ; U3#5.7 5.6,6.87 6.13,7.39 6.89,7.39 8.49,9 v1(8.49,10.19) ; U3#4.7 19.31,6.87 19.59,7.14 20.31,7.14 22.13,8.97 v1(22.13,10.19)
  Bottom Layer w0.254: 35.84,10.19 35.84,10.34 C9#3.2 ; 8.54,10.19 8.54,10.34 C9.2 ; 22.64,10.7 v1(22.13,10.19) ; 49.94,10.7 v1(49.43,10.19)
XTAL2: length 18.1
  Top Layer w0.254: v1(22.76,8.79) 23.27,8.79 ; v1(50.07,8.79) 50.58,8.79
  Bottom Layer w0.2: U3#5.8 6.38,6.37 8.54,8.54 v1(9.05,8.54) ; v1(22.76,8.79) 22.38,8.79 19.96,6.37 U3#4.8 ; U3#6.8 47.27,6.37 49.69,8.79 v1(50.07,8.79) ; U3#7.8 33.68,6.37 35.84,8.54 v1(36.35,8.54)
  Bottom Layer w0.254: v1(22.76,8.79) 22.99,9.02 C10#2.1 ; C10#4.1 50.3,9.02 v1(50.07,8.79)
$1N1156: length 1.6
  Bottom Layer w0.254: C7#2.2 18.34,1.53 U3#4.20 ; C7#4.2 45.65,1.53 U3#6.20
$1N1216: length 2.3
  Bottom Layer w0.254: 47.05,9.63 47.58,9.63 R4#4.2 ; 19.75,9.63 20.27,9.63 R4#2.2
$1N1217: length 1.8
  Bottom Layer w0.254: U2#3.10 47.96,9.23 ; U2#4.10 20.65,9.23
$1N1698: length 2.5
  Bottom Layer w0.2: 33.34,9.63 33.99,9.63 R4#3.2 ; 6.03,9.63 6.68,9.63 R4.2
$1N1725: length 2.2
  Bottom Layer w0.2: U2.10 34.35,9.23 C5#3.2 ; U2#2.10 7.04,9.23 C5.2

## Copper pours and planes (outline as drawn; the poured copper is in the pictures)
5V on Top Layer: 32.44,6.88 34.19,6.88 34.19,5.09 32.44,5.09
5V on Top Layer: 5.13,6.88 6.88,6.88 6.88,5.09 5.13,5.09
5V on Top Layer: 46.27,6.76 47.78,6.76 47.78,5.24 46.27,5.24
5V on Top Layer: 18.97,6.76 20.48,6.76 20.48,5.24 18.97,5.24
GND on Top Layer: 2.75,5.29 4.73,5.29 4.73,2.82 2.75,2.82
GND on Top Layer: 27.21,12.09 39.4,12.09 39.4,-0.1 27.21,-0.1
GND on Top Layer: 40.92,12.09 52.99,12.09 52.99,0.03 40.92,0.03
GND on Top Layer: 13.62,12.09 25.69,12.09 25.69,0.03 13.62,0.03
GND on Top Layer: -0.1,12.09 12.1,12.09 12.1,-0.1 -0.1,-0.1
GND on Top Layer: 30.06,5.29 32.04,5.29 32.04,2.82 30.06,2.82
GND on Bottom Layer: -0.1,12.09 12.1,12.09 12.1,-0.1 -0.1,-0.1
GND on Bottom Layer: 27.21,12.09 39.4,12.09 39.4,-0.1 27.21,-0.1
GND on Bottom Layer: 13.62,12.09 25.69,12.09 25.69,0.03 13.62,0.03
GND on Bottom Layer: 40.92,12.09 52.99,12.09 52.99,0.03 40.92,0.03

Small or netless copper shapes (teardrops, artwork), in the pictures only: 4 on Top Layer

## Text on the board
Top Silkscreen Layer: X | Y
